# EasyEDA Pro project 无线发射端.eprj (continued)
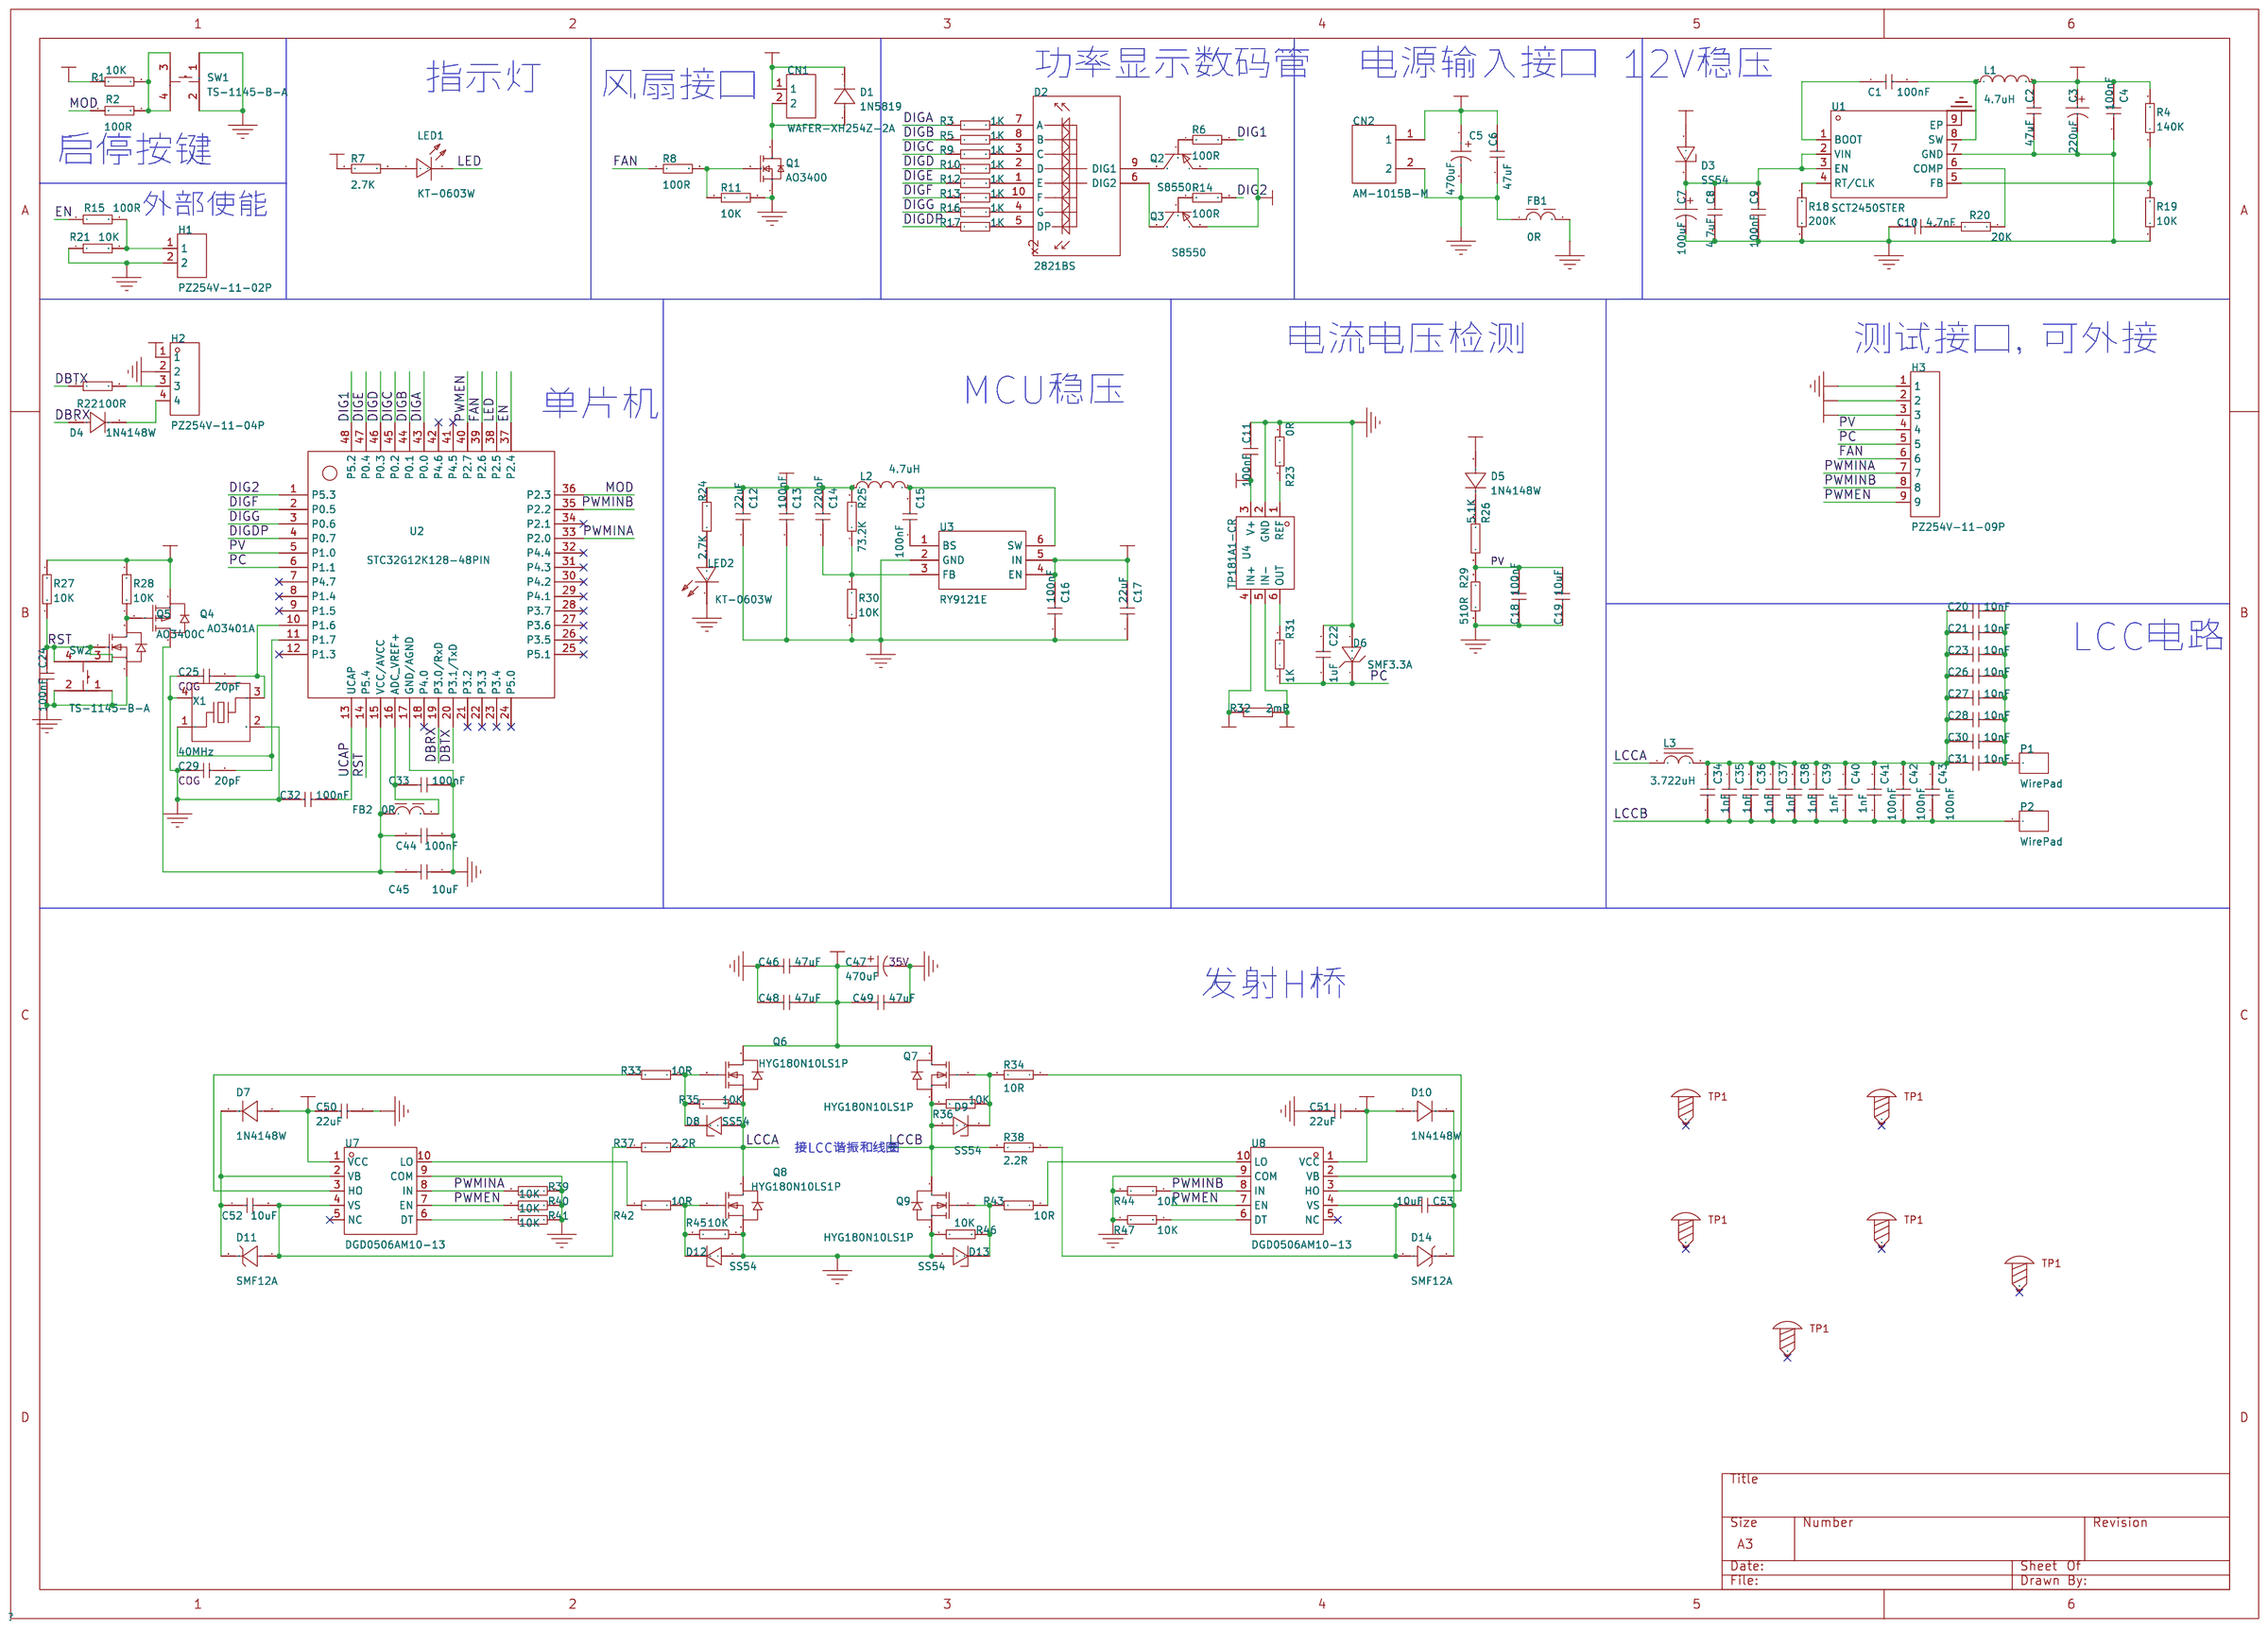
[diagram p0: schematic sheet]
## Library data of the parts (continued)
R1 R11 R19 R21 R27 R28 R30 R35 R36 R39-R41 R44-R47 = =Value+' '+Tolerance: 贴片电阻; Revision: V1.0; Tolerance: ±1%; Origin Footprint 2: RESC0603[0201]-L; Origin Footprint 3: RESC0603[0201]-M; Origin Footprint 4: RESC0603[0201]-N; Origin Footprint 5: RESC0603[0201]S-L; Origin Footprint 6: RESC0603[0201]S-M; Origin Footprint 7: RESC0603[0201]S-N; Origin Footprint 8: RESC1005[0402]-L; Origin Footprint 9: RESC1005[0402]-M; Origin Footprint 10: RESC1005[0402]-N; Origin Footprint 11: RESC1005[0402]S-L; Origin Footprint 12: RESC1005[0402]S-M; Origin Footprint 13: RESC1005[0402]S-N; Origin Footprint 14: RESC1608[0603]-L; Origin Footprint 15: RESC1608[0603]-M; Origin Footprint 16: RESC1608[0603]-N; Origin Footprint 17: RESC1608[0603]S-L; Origin Footprint 18: RESC1608[0603]S-M; Origin Footprint 19: RESC2012[0805]; Origin Footprint 20: RESC2012[0805]S-L; Origin Footprint 21: RESC2012[0805]S-M; Origin Footprint 22: RESC2012[0805]S-N; Origin Footprint 23: RESC3216[1206]; Origin Footprint 24: RESC3216[1206]S-L; Origin Footprint 25: RESC3216[1206]S-M; Origin Footprint 26: RESC3216[1206]S-N; Origin Footprint 27: RESC3225[1210]; Origin Footprint 28: RESC3225[1210]S; Origin Footprint 29: RESC5025[2010]; Origin Footprint 30: RESC5025[2010]S; Origin Footprint 31: RESC6332[2512]; Origin Footprint 32: RESC6332[2512]S; Origin Footprint 33: RESC0402[01005]-L; Origin Footprint 1: RESC1608[0603]S-N; Design Item ID: Res-Chip; Library Name: WirelessChargingHost_HBridge
R2 R6 R8 R14 R15 R22 = =Value+' '+Tolerance: 贴片电阻; Revision: V1.0; Tolerance: ±1%; Origin Footprint 2: RESC0603[0201]-L; Origin Footprint 3: RESC0603[0201]-M; Origin Footprint 4: RESC0603[0201]-N; Origin Footprint 5: RESC0603[0201]S-L; Origin Footprint 6: RESC0603[0201]S-M; Origin Footprint 7: RESC0603[0201]S-N; Origin Footprint 8: RESC1005[0402]-L; Origin Footprint 9: RESC1005[0402]-M; Origin Footprint 10: RESC1005[0402]-N; Origin Footprint 11: RESC1005[0402]S-L; Origin Footprint 12: RESC1005[0402]S-M; Origin Footprint 13: RESC1005[0402]S-N; Origin Footprint 14: RESC1608[0603]-L; Origin Footprint 15: RESC1608[0603]-M; Origin Footprint 16: RESC1608[0603]-N; Origin Footprint 17: RESC1608[0603]S-L; Origin Footprint 18: RESC1608[0603]S-M; Origin Footprint 19: RESC2012[0805]; Origin Footprint 20: RESC2012[0805]S-L; Origin Footprint 21: RESC2012[0805]S-M; Origin Footprint 22: RESC2012[0805]S-N; Origin Footprint 23: RESC3216[1206]; Origin Footprint 24: RESC3216[1206]S-L; Origin Footprint 25: RESC3216[1206]S-M; Origin Footprint 26: RESC3216[1206]S-N; Origin Footprint 27: RESC3225[1210]; Origin Footprint 28: RESC3225[1210]S; Origin Footprint 29: RESC5025[2010]; Origin Footprint 30: RESC5025[2010]S; Origin Footprint 31: RESC6332[2512]; Origin Footprint 32: RESC6332[2512]S; Origin Footprint 33: RESC0402[01005]-L; Origin Footprint 1: RESC1608[0603]S-N; Design Item ID: Res-Chip_1; Library Name: WirelessChargingHost_HBridge
R3 R5 R9 R10 R12 R13 R16 R17 R31 = =Value+' '+Tolerance: 贴片电阻; Revision: V1.0; Tolerance: ±1%; Origin Footprint 2: RESC0603[0201]-L; Origin Footprint 3: RESC0603[0201]-M; Origin Footprint 4: RESC0603[0201]-N; Origin Footprint 5: RESC0603[0201]S-L; Origin Footprint 6: RESC0603[0201]S-M; Origin Footprint 7: RESC0603[0201]S-N; Origin Footprint 8: RESC1005[0402]-L; Origin Footprint 9: RESC1005[0402]-M; Origin Footprint 10: RESC1005[0402]-N; Origin Footprint 11: RESC1005[0402]S-L; Origin Footprint 12: RESC1005[0402]S-M; Origin Footprint 13: RESC1005[0402]S-N; Origin Footprint 14: RESC1608[0603]-L; Origin Footprint 15: RESC1608[0603]-M; Origin Footprint 16: RESC1608[0603]-N; Origin Footprint 17: RESC1608[0603]S-L; Origin Footprint 18: RESC1608[0603]S-M; Origin Footprint 19: RESC2012[0805]; Origin Footprint 20: RESC2012[0805]S-L; Origin Footprint 21: RESC2012[0805]S-M; Origin Footprint 22: RESC2012[0805]S-N; Origin Footprint 23: RESC3216[1206]; Origin Footprint 24: RESC3216[1206]S-L; Origin Footprint 25: RESC3216[1206]S-M; Origin Footprint 26: RESC3216[1206]S-N; Origin Footprint 27: RESC3225[1210]; Origin Footprint 28: RESC3225[1210]S; Origin Footprint 29: RESC5025[2010]; Origin Footprint 30: RESC5025[2010]S; Origin Footprint 31: RESC6332[2512]; Origin Footprint 32: RESC6332[2512]S; Origin Footprint 33: RESC0402[01005]-L; Origin Footprint 1: RESC1608[0603]S-N; Design Item ID: Res-Chip_3; Library Name: WirelessChargingHost_HBridge
R4 = =Value+' '+Tolerance: 贴片电阻; Revision: V1.0; Tolerance: ±1%; Origin Footprint 2: RESC0603[0201]-L; Origin Footprint 3: RESC0603[0201]-M; Origin Footprint 4: RESC0603[0201]-N; Origin Footprint 5: RESC0603[0201]S-L; Origin Footprint 6: RESC0603[0201]S-M; Origin Footprint 7: RESC0603[0201]S-N; Origin Footprint 8: RESC1005[0402]-L; Origin Footprint 9: RESC1005[0402]-M; Origin Footprint 10: RESC1005[0402]-N; Origin Footprint 11: RESC1005[0402]S-L; Origin Footprint 12: RESC1005[0402]S-M; Origin Footprint 13: RESC1005[0402]S-N; Origin Footprint 14: RESC1608[0603]-L; Origin Footprint 15: RESC1608[0603]-M; Origin Footprint 16: RESC1608[0603]-N; Origin Footprint 17: RESC1608[0603]S-L; Origin Footprint 18: RESC1608[0603]S-M; Origin Footprint 19: RESC2012[0805]; Origin Footprint 20: RESC2012[0805]S-L; Origin Footprint 21: RESC2012[0805]S-M; Origin Footprint 22: RESC2012[0805]S-N; Origin Footprint 23: RESC3216[1206]; Origin Footprint 24: RESC3216[1206]S-L; Origin Footprint 25: RESC3216[1206]S-M; Origin Footprint 26: RESC3216[1206]S-N; Origin Footprint 27: RESC3225[1210]; Origin Footprint 28: RESC3225[1210]S; Origin Footprint 29: RESC5025[2010]; Origin Footprint 30: RESC5025[2010]S; Origin Footprint 31: RESC6332[2512]; Origin Footprint 32: RESC6332[2512]S; Origin Footprint 33: RESC0402[01005]-L; Origin Footprint 1: RESC1608[0603]S-N; Design Item ID: Res-Chip_6; Library Name: WirelessChargingHost_HBridge
R7 R24 = =Value+' '+Tolerance: 贴片电阻; Revision: V1.0; Tolerance: ±1%; Origin Footprint 2: RESC0603[0201]-L; Origin Footprint 3: RESC0603[0201]-M; Origin Footprint 4: RESC0603[0201]-N; Origin Footprint 5: RESC0603[0201]S-L; Origin Footprint 6: RESC0603[0201]S-M; Origin Footprint 7: RESC0603[0201]S-N; Origin Footprint 8: RESC1005[0402]-L; Origin Footprint 9: RESC1005[0402]-M; Origin Footprint 10: RESC1005[0402]-N; Origin Footprint 11: RESC1005[0402]S-L; Origin Footprint 12: RESC1005[0402]S-M; Origin Footprint 13: RESC1005[0402]S-N; Origin Footprint 14: RESC1608[0603]-L; Origin Footprint 15: RESC1608[0603]-M; Origin Footprint 16: RESC1608[0603]-N; Origin Footprint 17: RESC1608[0603]S-L; Origin Footprint 18: RESC1608[0603]S-M; Origin Footprint 19: RESC2012[0805]; Origin Footprint 20: RESC2012[0805]S-L; Origin Footprint 21: RESC2012[0805]S-M; Origin Footprint 22: RESC2012[0805]S-N; Origin Footprint 23: RESC3216[1206]; Origin Footprint 24: RESC3216[1206]S-L; Origin Footprint 25: RESC3216[1206]S-M; Origin Footprint 26: RESC3216[1206]S-N; Origin Footprint 27: RESC3225[1210]; Origin Footprint 28: RESC3225[1210]S; Origin Footprint 29: RESC5025[2010]; Origin Footprint 30: RESC5025[2010]S; Origin Footprint 31: RESC6332[2512]; Origin Footprint 32: RESC6332[2512]S; Origin Footprint 33: RESC0402[01005]-L; Origin Footprint 1: RESC1608[0603]S-N; Design Item ID: Res-Chip_2; Library Name: WirelessChargingHost_HBridge
R18 = =Value+' '+Tolerance: 贴片电阻; Revision: V1.0; Tolerance: ±1%; Origin Footprint 2: RESC0603[0201]-L; Origin Footprint 3: RESC0603[0201]-M; Origin Footprint 4: RESC0603[0201]-N; Origin Footprint 5: RESC0603[0201]S-L; Origin Footprint 6: RESC0603[0201]S-M; Origin Footprint 7: RESC0603[0201]S-N; Origin Footprint 8: RESC1005[0402]-L; Origin Footprint 9: RESC1005[0402]-M; Origin Footprint 10: RESC1005[0402]-N; Origin Footprint 11: RESC1005[0402]S-L; Origin Footprint 12: RESC1005[0402]S-M; Origin Footprint 13: RESC1005[0402]S-N; Origin Footprint 14: RESC1608[0603]-L; Origin Footprint 15: RESC1608[0603]-M; Origin Footprint 16: RESC1608[0603]-N; Origin Footprint 17: RESC1608[0603]S-L; Origin Footprint 18: RESC1608[0603]S-M; Origin Footprint 19: RESC2012[0805]; Origin Footprint 20: RESC2012[0805]S-L; Origin Footprint 21: RESC2012[0805]S-M; Origin Footprint 22: RESC2012[0805]S-N; Origin Footprint 23: RESC3216[1206]; Origin Footprint 24: RESC3216[1206]S-L; Origin Footprint 25: RESC3216[1206]S-M; Origin Footprint 26: RESC3216[1206]S-N; Origin Footprint 27: RESC3225[1210]; Origin Footprint 28: RESC3225[1210]S; Origin Footprint 29: RESC5025[2010]; Origin Footprint 30: RESC5025[2010]S; Origin Footprint 31: RESC6332[2512]; Origin Footprint 32: RESC6332[2512]S; Origin Footprint 33: RESC0402[01005]-L; Origin Footprint 1: RESC1608[0603]S-N; Design Item ID: Res-Chip_4; Library Name: WirelessChargingHost_HBridge
R20 = =Value+' '+Tolerance: 贴片电阻; Revision: V1.0; Tolerance: ±1%; Origin Footprint 2: RESC0603[0201]-L; Origin Footprint 3: RESC0603[0201]-M; Origin Footprint 4: RESC0603[0201]-N; Origin Footprint 5: RESC0603[0201]S-L; Origin Footprint 6: RESC0603[0201]S-M; Origin Footprint 7: RESC0603[0201]S-N; Origin Footprint 8: RESC1005[0402]-L; Origin Footprint 9: RESC1005[0402]-M; Origin Footprint 10: RESC1005[0402]-N; Origin Footprint 11: RESC1005[0402]S-L; Origin Footprint 12: RESC1005[0402]S-M; Origin Footprint 13: RESC1005[0402]S-N; Origin Footprint 14: RESC1608[0603]-L; Origin Footprint 15: RESC1608[0603]-M; Origin Footprint 16: RESC1608[0603]-N; Origin Footprint 17: RESC1608[0603]S-L; Origin Footprint 18: RESC1608[0603]S-M; Origin Footprint 19: RESC2012[0805]; Origin Footprint 20: RESC2012[0805]S-L; Origin Footprint 21: RESC2012[0805]S-M; Origin Footprint 22: RESC2012[0805]S-N; Origin Footprint 23: RESC3216[1206]; Origin Footprint 24: RESC3216[1206]S-L; Origin Footprint 25: RESC3216[1206]S-M; Origin Footprint 26: RESC3216[1206]S-N; Origin Footprint 27: RESC3225[1210]; Origin Footprint 28: RESC3225[1210]S; Origin Footprint 29: RESC5025[2010]; Origin Footprint 30: RESC5025[2010]S; Origin Footprint 31: RESC6332[2512]; Origin Footprint 32: RESC6332[2512]S; Origin Footprint 33: RESC0402[01005]-L; Origin Footprint 1: RESC1608[0603]S-N; Design Item ID: Res-Chip_5; Library Name: WirelessChargingHost_HBridge
R23 = =Value+' '+Tolerance: 贴片电阻; Revision: V1.0; Tolerance: ±1%; Origin Footprint 2: RESC0603[0201]-L; Origin Footprint 3: RESC0603[0201]-M; Origin Footprint 4: RESC0603[0201]-N; Origin Footprint 5: RESC0603[0201]S-L; Origin Footprint 6: RESC0603[0201]S-M; Origin Footprint 7: RESC0603[0201]S-N; Origin Footprint 8: RESC1005[0402]-L; Origin Footprint 9: RESC1005[0402]-M; Origin Footprint 10: RESC1005[0402]-N; Origin Footprint 11: RESC1005[0402]S-L; Origin Footprint 12: RESC1005[0402]S-M; Origin Footprint 13: RESC1005[0402]S-N; Origin Footprint 14: RESC1608[0603]-L; Origin Footprint 15: RESC1608[0603]-M; Origin Footprint 16: RESC1608[0603]-N; Origin Footprint 17: RESC1608[0603]S-L; Origin Footprint 18: RESC1608[0603]S-M; Origin Footprint 19: RESC2012[0805]; Origin Footprint 20: RESC2012[0805]S-L; Origin Footprint 21: RESC2012[0805]S-M; Origin Footprint 22: RESC2012[0805]S-N; Origin Footprint 23: RESC3216[1206]; Origin Footprint 24: RESC3216[1206]S-L; Origin Footprint 25: RESC3216[1206]S-M; Origin Footprint 26: RESC3216[1206]S-N; Origin Footprint 27: RESC3225[1210]; Origin Footprint 28: RESC3225[1210]S; Origin Footprint 29: RESC5025[2010]; Origin Footprint 30: RESC5025[2010]S; Origin Footprint 31: RESC6332[2512]; Origin Footprint 32: RESC6332[2512]S; Origin Footprint 33: RESC0402[01005]-L; Origin Footprint 1: RESC1608[0603]S-N; Design Item ID: Res-Chip_10; Library Name: WirelessChargingHost_HBridge
R25 = =Value+' '+Tolerance: 贴片电阻; Revision: V1.0; Tolerance: ±1%; Origin Footprint 2: RESC0603[0201]-L; Origin Footprint 3: RESC0603[0201]-M; Origin Footprint 4: RESC0603[0201]-N; Origin Footprint 5: RESC0603[0201]S-L; Origin Footprint 6: RESC0603[0201]S-M; Origin Footprint 7: RESC0603[0201]S-N; Origin Footprint 8: RESC1005[0402]-L; Origin Footprint 9: RESC1005[0402]-M; Origin Footprint 10: RESC1005[0402]-N; Origin Footprint 11: RESC1005[0402]S-L; Origin Footprint 12: RESC1005[0402]S-M; Origin Footprint 13: RESC1005[0402]S-N; Origin Footprint 14: RESC1608[0603]-L; Origin Footprint 15: RESC1608[0603]-M; Origin Footprint 16: RESC1608[0603]-N; Origin Footprint 17: RESC1608[0603]S-L; Origin Footprint 18: RESC1608[0603]S-M; Origin Footprint 19: RESC2012[0805]; Origin Footprint 20: RESC2012[0805]S-L; Origin Footprint 21: RESC2012[0805]S-M; Origin Footprint 22: RESC2012[0805]S-N; Origin Footprint 23: RESC3216[1206]; Origin Footprint 24: RESC3216[1206]S-L; Origin Footprint 25: RESC3216[1206]S-M; Origin Footprint 26: RESC3216[1206]S-N; Origin Footprint 27: RESC3225[1210]; Origin Footprint 28: RESC3225[1210]S; Origin Footprint 29: RESC5025[2010]; Origin Footprint 30: RESC5025[2010]S; Origin Footprint 31: RESC6332[2512]; Origin Footprint 32: RESC6332[2512]S; Origin Footprint 33: RESC0402[01005]-L; Origin Footprint 1: RESC1608[0603]S-N; Design Item ID: Res-Chip_7; Library Name: WirelessChargingHost_HBridge
R26 = =Value+' '+Tolerance: 贴片电阻; Revision: V1.0; Tolerance: ±1%; Origin Footprint 2: RESC0603[0201]-L; Origin Footprint 3: RESC0603[0201]-M; Origin Footprint 4: RESC0603[0201]-N; Origin Footprint 5: RESC0603[0201]S-L; Origin Footprint 6: RESC0603[0201]S-M; Origin Footprint 7: RESC0603[0201]S-N; Origin Footprint 8: RESC1005[0402]-L; Origin Footprint 9: RESC1005[0402]-M; Origin Footprint 10: RESC1005[0402]-N; Origin Footprint 11: RESC1005[0402]S-L; Origin Footprint 12: RESC1005[0402]S-M; Origin Footprint 13: RESC1005[0402]S-N; Origin Footprint 14: RESC1608[0603]-L; Origin Footprint 15: RESC1608[0603]-M; Origin Footprint 16: RESC1608[0603]-N; Origin Footprint 17: RESC1608[0603]S-L; Origin Footprint 18: RESC1608[0603]S-M; Origin Footprint 19: RESC2012[0805]; Origin Footprint 20: RESC2012[0805]S-L; Origin Footprint 21: RESC2012[0805]S-M; Origin Footprint 22: RESC2012[0805]S-N; Origin Footprint 23: RESC3216[1206]; Origin Footprint 24: RESC3216[1206]S-L; Origin Footprint 25: RESC3216[1206]S-M; Origin Footprint 26: RESC3216[1206]S-N; Origin Footprint 27: RESC3225[1210]; Origin Footprint 28: RESC3225[1210]S; Origin Footprint 29: RESC5025[2010]; Origin Footprint 30: RESC5025[2010]S; Origin Footprint 31: RESC6332[2512]; Origin Footprint 32: RESC6332[2512]S; Origin Footprint 33: RESC0402[01005]-L; Origin Footprint 1: RESC1608[0603]S-N; Design Item ID: Res-Chip_8; Library Name: WirelessChargingHost_HBridge
R29 = =Value+' '+Tolerance: 贴片电阻; Revision: V1.0; Tolerance: ±1%; Origin Footprint 2: RESC0603[0201]-L; Origin Footprint 3: RESC0603[0201]-M; Origin Footprint 4: RESC0603[0201]-N; Origin Footprint 5: RESC0603[0201]S-L; Origin Footprint 6: RESC0603[0201]S-M; Origin Footprint 7: RESC0603[0201]S-N; Origin Footprint 8: RESC1005[0402]-L; Origin Footprint 9: RESC1005[0402]-M; Origin Footprint 10: RESC1005[0402]-N; Origin Footprint 11: RESC1005[0402]S-L; Origin Footprint 12: RESC1005[0402]S-M; Origin Footprint 13: RESC1005[0402]S-N; Origin Footprint 14: RESC1608[0603]-L; Origin Footprint 15: RESC1608[0603]-M; Origin Footprint 16: RESC1608[0603]-N; Origin Footprint 17: RESC1608[0603]S-L; Origin Footprint 18: RESC1608[0603]S-M; Origin Footprint 19: RESC2012[0805]; Origin Footprint 20: RESC2012[0805]S-L; Origin Footprint 21: RESC2012[0805]S-M; Origin Footprint 22: RESC2012[0805]S-N; Origin Footprint 23: RESC3216[1206]; Origin Footprint 24: RESC3216[1206]S-L; Origin Footprint 25: RESC3216[1206]S-M; Origin Footprint 26: RESC3216[1206]S-N; Origin Footprint 27: RESC3225[1210]; Origin Footprint 28: RESC3225[1210]S; Origin Footprint 29: RESC5025[2010]; Origin Footprint 30: RESC5025[2010]S; Origin Footprint 31: RESC6332[2512]; Origin Footprint 32: RESC6332[2512]S; Origin Footprint 33: RESC0402[01005]-L; Origin Footprint 1: RESC1608[0603]S-N; Design Item ID: Res-Chip_9; Library Name: WirelessChargingHost_HBridge
R32 = =Value+' '+Tolerance: 贴片电阻; Revision: V1.0; Tolerance: ±1%; Origin Footprint 2: RESC0603[0201]-L; Origin Footprint 3: RESC0603[0201]-M; Origin Footprint 4: RESC0603[0201]-N; Origin Footprint 5: RESC0603[0201]S-L; Origin Footprint 6: RESC0603[0201]S-M; Origin Footprint 7: RESC0603[0201]S-N; Origin Footprint 8: RESC1005[0402]-L; Origin Footprint 9: RESC1005[0402]-M; Origin Footprint 10: RESC1005[0402]-N; Origin Footprint 11: RESC1005[0402]S-L; Origin Footprint 12: RESC1005[0402]S-M; Origin Footprint 13: RESC1005[0402]S-N; Origin Footprint 14: RESC1608[0603]-L; Origin Footprint 15: RESC1608[0603]-M; Origin Footprint 16: RESC1608[0603]-N; Origin Footprint 17: RESC1608[0603]S-L; Origin Footprint 18: RESC1608[0603]S-M; Origin Footprint 19: RESC1608[0603]S-N; Origin Footprint 20: RESC2012[0805]; Origin Footprint 21: RESC2012[0805]S-L; Origin Footprint 22: RESC2012[0805]S-M; Origin Footprint 23: RESC2012[0805]S-N; Origin Footprint 24: RESC3216[1206]; Origin Footprint 25: RESC3216[1206]S-L; Origin Footprint 26: RESC3216[1206]S-M; Origin Footprint 27: RESC3216[1206]S-N; Origin Footprint 28: RESC3225[1210]; Origin Footprint 29: RESC3225[1210]S; Origin Footprint 30: RESC5025[2010]; Origin Footprint 31: RESC5025[2010]S; Origin Footprint 32: RESC6332[2512]; Origin Footprint 33: RESC0402[01005]-L; Origin Footprint 1: RESC6332[2512]S; Design Item ID: Res-Chip_11; Library Name: WirelessChargingHost_HBridge
R33 R34 R42 R43 = =Value+' '+Tolerance: 贴片电阻; Revision: V1.0; Tolerance: ±1%; Origin Footprint 2: RESC0603[0201]-L; Origin Footprint 3: RESC0603[0201]-M; Origin Footprint 4: RESC0603[0201]-N; Origin Footprint 5: RESC0603[0201]S-L; Origin Footprint 6: RESC0603[0201]S-M; Origin Footprint 7: RESC0603[0201]S-N; Origin Footprint 8: RESC1005[0402]-L; Origin Footprint 9: RESC1005[0402]-M; Origin Footprint 10: RESC1005[0402]-N; Origin Footprint 11: RESC1005[0402]S-L; Origin Footprint 12: RESC1005[0402]S-M; Origin Footprint 13: RESC1005[0402]S-N; Origin Footprint 14: RESC1608[0603]-L; Origin Footprint 15: RESC1608[0603]-M; Origin Footprint 16: RESC1608[0603]-N; Origin Footprint 17: RESC1608[0603]S-L; Origin Footprint 18: RESC1608[0603]S-M; Origin Footprint 19: RESC1608[0603]S-N; Origin Footprint 20: RESC2012[0805]; Origin Footprint 21: RESC2012[0805]S-L; Origin Footprint 22: RESC2012[0805]S-M; Origin Footprint 23: RESC3216[1206]; Origin Footprint 24: RESC3216[1206]S-L; Origin Footprint 25: RESC3216[1206]S-M; Origin Footprint 26: RESC3216[1206]S-N; Origin Footprint 27: RESC3225[1210]; Origin Footprint 28: RESC3225[1210]S; Origin Footprint 29: RESC5025[2010]; Origin Footprint 30: RESC5025[2010]S; Origin Footprint 31: RESC6332[2512]; Origin Footprint 32: RESC6332[2512]S; Origin Footprint 33: RESC0402[01005]-L; Origin Footprint 1: RESC2012[0805]S-N; Design Item ID: Res-Chip_12; Library Name: WirelessChargingHost_HBridge
R37 R38 = =Value+' '+Tolerance: 贴片电阻; Revision: V1.0; Tolerance: ±1%; Origin Footprint 2: RESC0603[0201]-L; Origin Footprint 3: RESC0603[0201]-M; Origin Footprint 4: RESC0603[0201]-N; Origin Footprint 5: RESC0603[0201]S-L; Origin Footprint 6: RESC0603[0201]S-M; Origin Footprint 7: RESC0603[0201]S-N; Origin Footprint 8: RESC1005[0402]-L; Origin Footprint 9: RESC1005[0402]-M; Origin Footprint 10: RESC1005[0402]-N; Origin Footprint 11: RESC1005[0402]S-L; Origin Footprint 12: RESC1005[0402]S-M; Origin Footprint 13: RESC1005[0402]S-N; Origin Footprint 14: RESC1608[0603]-L; Origin Footprint 15: RESC1608[0603]-M; Origin Footprint 16: RESC1608[0603]-N; Origin Footprint 17: RESC1608[0603]S-L; Origin Footprint 18: RESC1608[0603]S-M; Origin Footprint 19: RESC1608[0603]S-N; Origin Footprint 20: RESC2012[0805]; Origin Footprint 21: RESC2012[0805]S-L; Origin Footprint 22: RESC2012[0805]S-M; Origin Footprint 23: RESC3216[1206]; Origin Footprint 24: RESC3216[1206]S-L; Origin Footprint 25: RESC3216[1206]S-M; Origin Footprint 26: RESC3216[1206]S-N; Origin Footprint 27: RESC3225[1210]; Origin Footprint 28: RESC3225[1210]S; Origin Footprint 29: RESC5025[2010]; Origin Footprint 30: RESC5025[2010]S; Origin Footprint 31: RESC6332[2512]; Origin Footprint 32: RESC6332[2512]S; Origin Footprint 33: RESC0402[01005]-L; Origin Footprint 1: RESC2012[0805]S-N; Design Item ID: Res-Chip_13; Library Name: WirelessChargingHost_HBridge
SW1 SW2 = TS-1145-B-A: LCSC Part Name: 4.2*3.2*2.5mm 立贴 轻触开关; Supplier Part: C561524; Manufacturer: XKB Connectivity(中国星坤); Supplier Footprint: SMD; JLCPCB Part Class: 扩展库; Datasheet: https://atta.szlcsc.com/upload/public/pdf/source/20211011/0CF8142AA4E06969C17548F8C3FC4FC4.pdf; Supplier: LCSC; Circuit: 单刀单掷; Actuator Style: 椭圆形按钮; Operating Force: 160gf; Mounting Style: 立贴; Switch Length: 4.2mm; Switch Width: 3.2mm; Switch Height: 2.5mm; Strike Gundam: 不带; Contact Current: 50mA; Voltage Rating (DC): 12V; Actuator/Cap Color: 白色; With Lamp: 无; Mechanical Life: 10万次; Operating Temperature: -30℃~+85℃
U1 = SCT2450STER: LCSC Part Name: 3.8V-36V输入，5A输出，高效率同步降压DC-DC转换器; Supplier Part: C509400; Manufacturer: SCT(芯洲科技); Supplier Footprint: ESOP-8; JLCPCB Part Class: 扩展库; Datasheet: https://atta.szlcsc.com/upload/public/pdf/source/20200407/C509400_EDF779A672A59398CFBA9E95FA584FEC.pdf; Supplier: LCSC; Function: 降压型; Input Voltage: 3.8V~36V; Output Current: 5A; Switching Frequency: 100kHz~1.1MHz; Operating Temperature: -40℃~+125℃@(TJ); Synchronous Rectification: 是; Number of Outputs: 1; Switch tube (built-in/external): 内置
U2 = STC32G12K128-48PIN: STC32G12K128 LQFP48; Origin Footprint 2: LQFP48_M; Origin Footprint 3: LQFP48_N; Library Name: WirelessChargingHost_HBridge
U3 = RY9121E: 17V 2A 1.2MHz Synchronous Step-Down Regulator; Revision: V1.0; Library Name: WirelessChargingHost_HBridge
U4 = TP181A1-CR: Supplier Part: C2902349; Manufacturer: 3PEAK(思瑞浦); Supplier Footprint: SC70-6; JLCPCB Part Class: 扩展库; Datasheet: https://atta.szlcsc.com/upload/public/pdf/source/20230301/6D62DABF8769A8088870FFE026FF2C6D.pdf; Supplier: LCSC
U5 U6 U9-U12 = M3
U7 U8 = DGD0506AM10-13: Supplier Part: C460681; Manufacturer: DIODES(美台); Supplier Footprint: MSOP-10; JLCPCB Part Class: 扩展库; Datasheet: https://atta.szlcsc.com/upload/public/pdf/source/20191127/C460681_4B1B82C0F5F9A7DCBB428D49CC6CA71A.pdf; Supplier: LCSC; Driven Configuration: 半桥; Load Type: MOSFET; Number of Drivers: 2; Peak Output Current(sink): 2A; Peak Output Current(source): 1.5A; Supply Voltage: 8V~14V; Rise Time: 17ns; Fall Time: 12ns; Operating Temperature: -40℃~+150℃@(Tj)
X1 = X322540MMB4SI: LCSC Part Name: 40MHz ±10ppm 10pF; Supplier Part: C5210647; Manufacturer: YXC(扬兴晶振); Supplier Footprint: SMD3225-4P; JLCPCB Part Class: 扩展库; Datasheet: https://atta.szlcsc.com/upload/public/pdf/source/20240329/19D5F850207469550BEB00D7DFEDBC7A.pdf; Supplier: LCSC; Type: 贴片晶振; Normal temperature Frequency Tolerance: ±10ppm; Load Capacitance: 10pF; Frequency Stability: ±20ppm; Operating Temperature: -40℃~+85℃

## Nets
GND: C2.1 C3.2 C4.1 C5.2 C6.1 C7.2 C8.1 C9.1 C10.1 C12.1 C13.1 C16.1 C17.1 C18.1 C19.1 C46.1 C47.2 C48.1 C49.2 C50.2 C51.2 CN2.2 D12.1(A) D13.1(A) FB1.1 H1.2 Q1.2(S) Q8.3(S) Q9.3(S) R11.2 R18.1 R19.1 R21.1 R29.1 R30.1 R39.2 R40.2 R41.2 R44.2 R45.2 R46.1 R47.2 U1.7(GND) U1.9(EP) U3.2(GND) U7.9(COM) U8.9(COM)
GNDMCU: C11.2 C22.2 C24.1 C25.1 C29.1 C32.1 C33.2 C44.2 C45.2 D6.2 FB1.2 H2.2 H3.1 LED2.2(K) Q5.2(S) R23.2 SW1.1 SW1.2 SW2.1 SW2.2 U2.17(GND/AGND) U4.2(GND) X1.2(GND) X1.4(GND)
VBAT: C5.1 C6.2 CN2.1 D3.1(A) R32.1 U4.4(IN+)
VBATO: C46.2 C47.1 C48.2 C49.1 D5.2(A) Q6.2(D) Q7.2(D) R32.2 U4.5(IN-)
+5: C11.1 C12.2 C13.2 C14.2 H2.1 H3.3 L2.1 Q2.2(E) Q3.2(E) Q4.2(S) R1.1 R7.1 R24.2 R25.2 R27.2 R28.2 U4.3(V+)
+12: C2.2 C3.1 C4.2 C16.2 C17.2 C50.1 C51.1 CN1.1 D1.1(K) D7.2(A) D10.2(A) H3.2 L1.2 R4.2 U3.4(EN) U3.5(IN) U7.1(VCC) U8.1(VCC)
DBRX: D4.2(A) U2.19(P3.0/RxD)
DBTX: R22.1 U2.20(P3.1/TxD)
DIG1: R6.2 U2.48(P5.2)
DIG2: R14.2 U2.1(P5.3)
DIGA: R3.1 U2.43(P0.0)
DIGB: R5.1 U2.44(P0.1)
DIGC: R9.1 U2.45(P0.2)
DIGD: R10.1 U2.46(P0.3)
DIGDP: R17.1 U2.4(P0.7)
DIGE: R12.1 U2.47(P0.4)
DIGF: R13.1 U2.2(P0.5)
DIGG: R16.1 U2.3(P0.6)
EN: R15.1 U2.37(P2.4)
FAN: H3.6 R8.1 U2.39(P2.6)
LCCA: D8.1(A) L3.1 Q6.3(S) Q8.2(D) R35.2 R37.2
LCCB: C34.1 C35.1 C36.1 C37.1 C38.1 C39.1 C40.1 C41.1 C42.1 C43.1 D9.1(A) P2.1 Q7.3(S) Q9.2(D) R36.1 R38.2
LED: LED1.2(K) U2.38(P2.5)
MOD: R2.1 U2.36(P2.3)
PC: C22.1 D6.1 H3.5 R31.1 U2.6(P1.1)
PV: C18.2 C19.2 H3.4 R26.1 R29.2 U2.5(P1.0)
PWMEN: H3.9 R40.1 U2.40(P2.7) U7.7(EN) U8.7(EN)
PWMINA: H3.7 R39.1 U2.33(P2.0) U7.8(IN)
PWMINB: H3.8 R44.1 U2.35(P2.2) U8.8(IN)
RST: C24.2 Q5.1(G) R27.1 SW2.3 SW2.4 U2.14(P5.4)
UCAP: C32.2 U2.13(UCAP)
$1N1: R1.2 R2.2 SW1.3 SW1.4
$1N5: H1.1 R15.2 R21.2
$1N9: CN1.2 D1.2(A) Q1.3(D)
$1N11: Q1.1(G) R8.2 R11.1
$1N21: D2.6(DIG2) Q3.3(C)
$1N25: H2.3 R22.2
$1N27: D4.1(C) H2.4
$1N51: C33.1 FB2.2 U2.16(ADC_VREF+)
$1N55: C25.2 U2.10(P1.6) X1.3
$1N57: C29.2 U2.11(P1.7) X1.1
$1N65: C1.1 U1.1(BOOT)
$1N66: C1.2 L1.1 U1.8(SW)
$1N70: R20.2 U1.6(COMP)
$1N71: R4.1 R19.2 U1.5(FB)
$1N73: C7.1 C8.2 C9.2 D3.2(K) U1.2(VIN) U1.3(EN)
$1N78: C14.1 R25.1 R30.2 U3.3(FB)
$1N80: C15.2 L2.2 U3.6(SW)
$1N98: C20.2 C21.2 C23.2 C26.2 C27.2 C28.2 C30.2 C31.2 P1.1
$1N99: C20.1 C21.1 C23.1 C26.1 C27.1 C28.1 C30.1 C31.1 C34.2 C35.2 C36.2 C37.2 C38.2 C39.2 C40.2 C41.2 C42.2 C43.2 L3.2
$1N103: C52.1 D7.1(C) D11.2(K) U7.2(VB)
$1N105: C52.2 D11.1(A) R37.1 U7.4(VS)
$1N108: R41.1 U7.6(DT)
$1N110: R33.1 U7.3(HO)
$1N112: D8.2(K) Q6.1(G) R33.2 R35.1
$1N113: R42.1 U7.10(LO)
$1N114: D12.2(K) Q8.1(G) R42.2 R45.1
$1N116: D13.2(K) Q9.1(G) R43.2 R46.2
$1N119: C53.1 D10.1(C) D14.2(K) U8.2(VB)
$1N121: C53.2 D14.1(A) R38.1 U8.4(VS)
$1N122: R47.1 U8.6(DT)
$1N124: R34.1 U8.3(HO)
$1N125: R43.1 U8.10(LO)
$1N4011: D2.7(A) R3.2
$1N4012: D2.8(B) R5.2
$1N4013: D2.3(C) R9.2
$1N4014: D2.2(D) R10.2
$1N4015: D2.1(E) R12.2
$1N4016: D2.10(F) R13.2
$1N4017: D2.4(G) R16.2
$1N4018: D2.5(DP) R17.2
$1N4028: C10.2 R20.1
$1N4031: C15.1 U3.1(BS)
$1N18905: C44.1 C45.1 FB2.1 Q4.3(D) U2.15(VCC/AVCC)
$1N27626: D9.2(K) Q7.1(G) R34.2 R36.2
$1N28676: D5.1(C) R26.2
$1N29134: LED2.1(A) R24.1
$1N29232: LED1.1(A) R7.2
$1N29318: Q4.1(G) Q5.3(D) R28.1
$1N29752: Q3.1(B) R14.1
$1N29880: D2.9(DIG1) Q2.3(C)
$1N29882: Q2.1(B) R6.1
$1N30040: R18.2 U1.4(RT/CLK)
$1N30225: R23.1 U4.1(REF)
$1N30230: R31.2 U4.6(OUT)

Not connected (* = marked no-connect by the designer): U2 7(P4.7)* 8(P1.4)* 9(P1.5)* 12(P1.3)* 18(P4.0)* 21(P3.2)* 22(P3.3)* 23(P3.4)* 24(P5.0)* 25(P5.1)* 26(P3.5)* 27(P3.6)* 28(P3.7)* 29(P4.1)* 30(P4.2)* 31(P4.3)* 32(P4.4)* 34(P2.1)* 41(P4.5)* 42(P4.6)*; U5 1*; U6 1*; U7 5(NC)*; U8 5(NC)*; U9 1*; U10 1*; U11 1*; U12 1*

## Notes on the sheet
- 功率显示数码管
- 电源输入接口
- 12V稳压
- 指示灯
- 风扇接口
- 启停按键
- 外部使能
- 电流电压检测
- 测试接口，可外接
- MCU稳压
- 单片机
- LCC电路
- 发射H桥
- 接LCC谐振和线圈
